# EasyEDA Pro project URADORRY-SUN1.2.eprj, schematic Main(1.2) (continued)
## Sheets (continued)
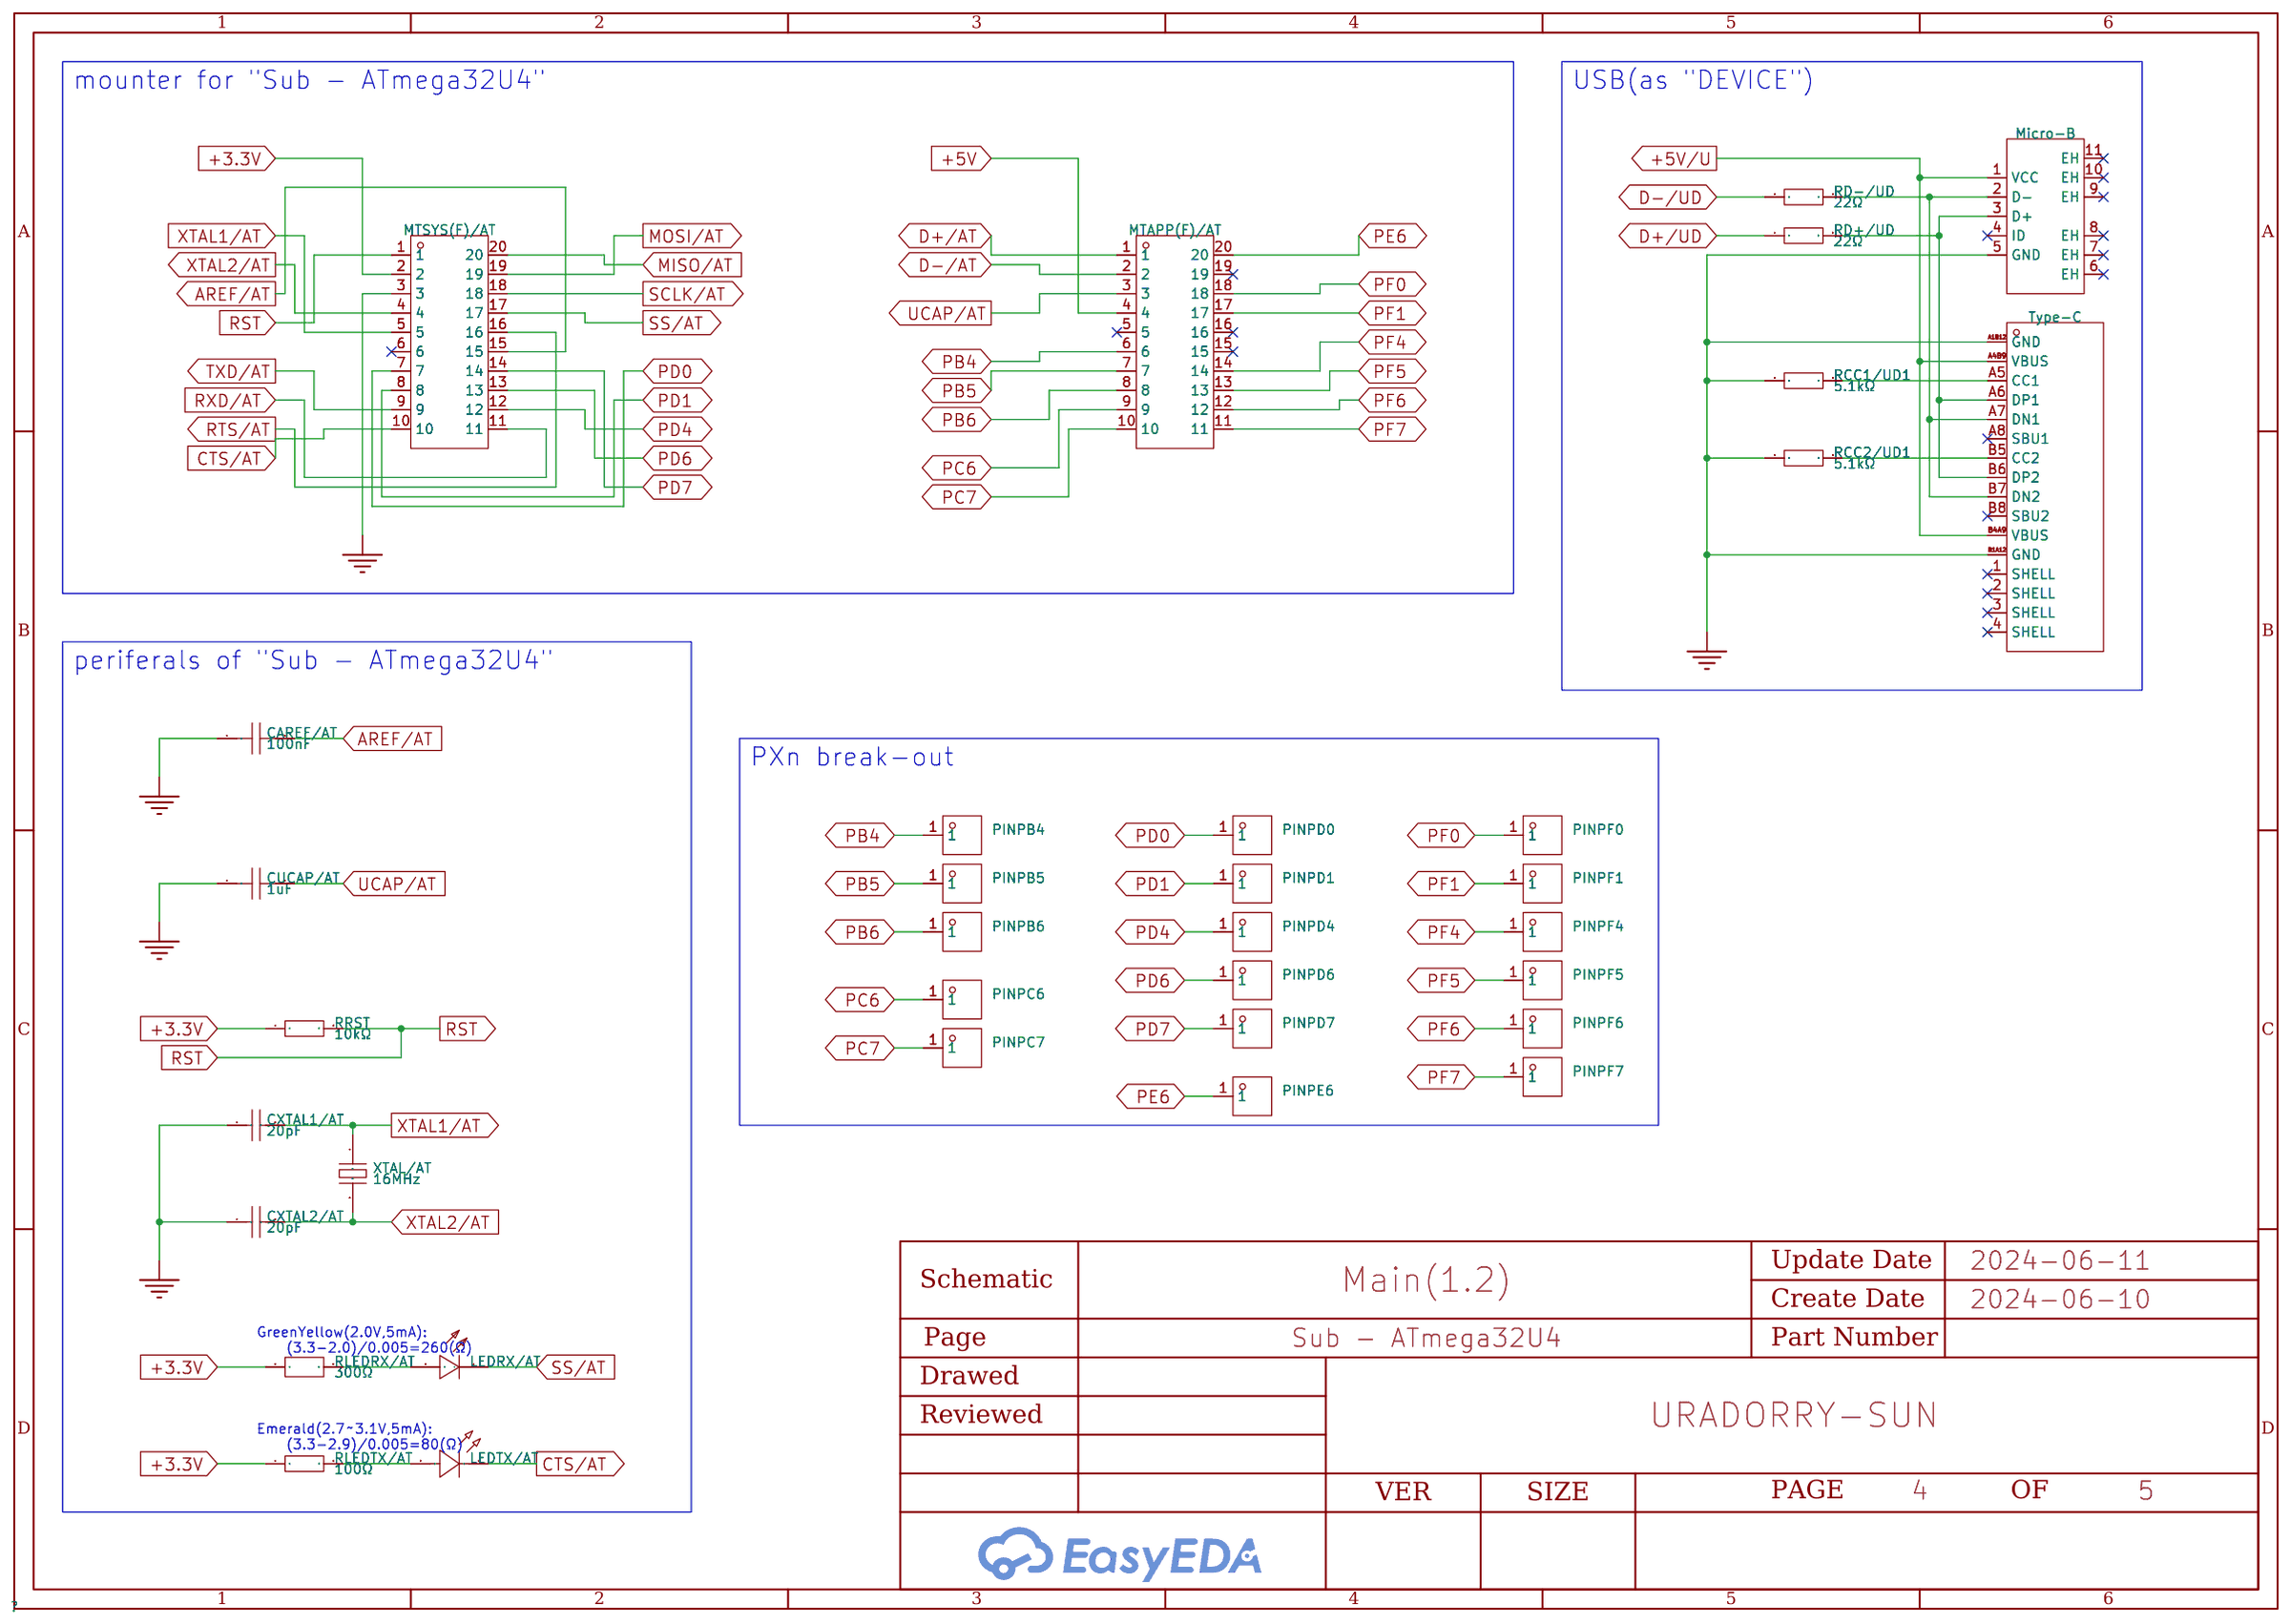
[diagram p5: Sub - ATmega32U4]
5 Sub - MAX3421E: Page Name: Sub - MAX3421E
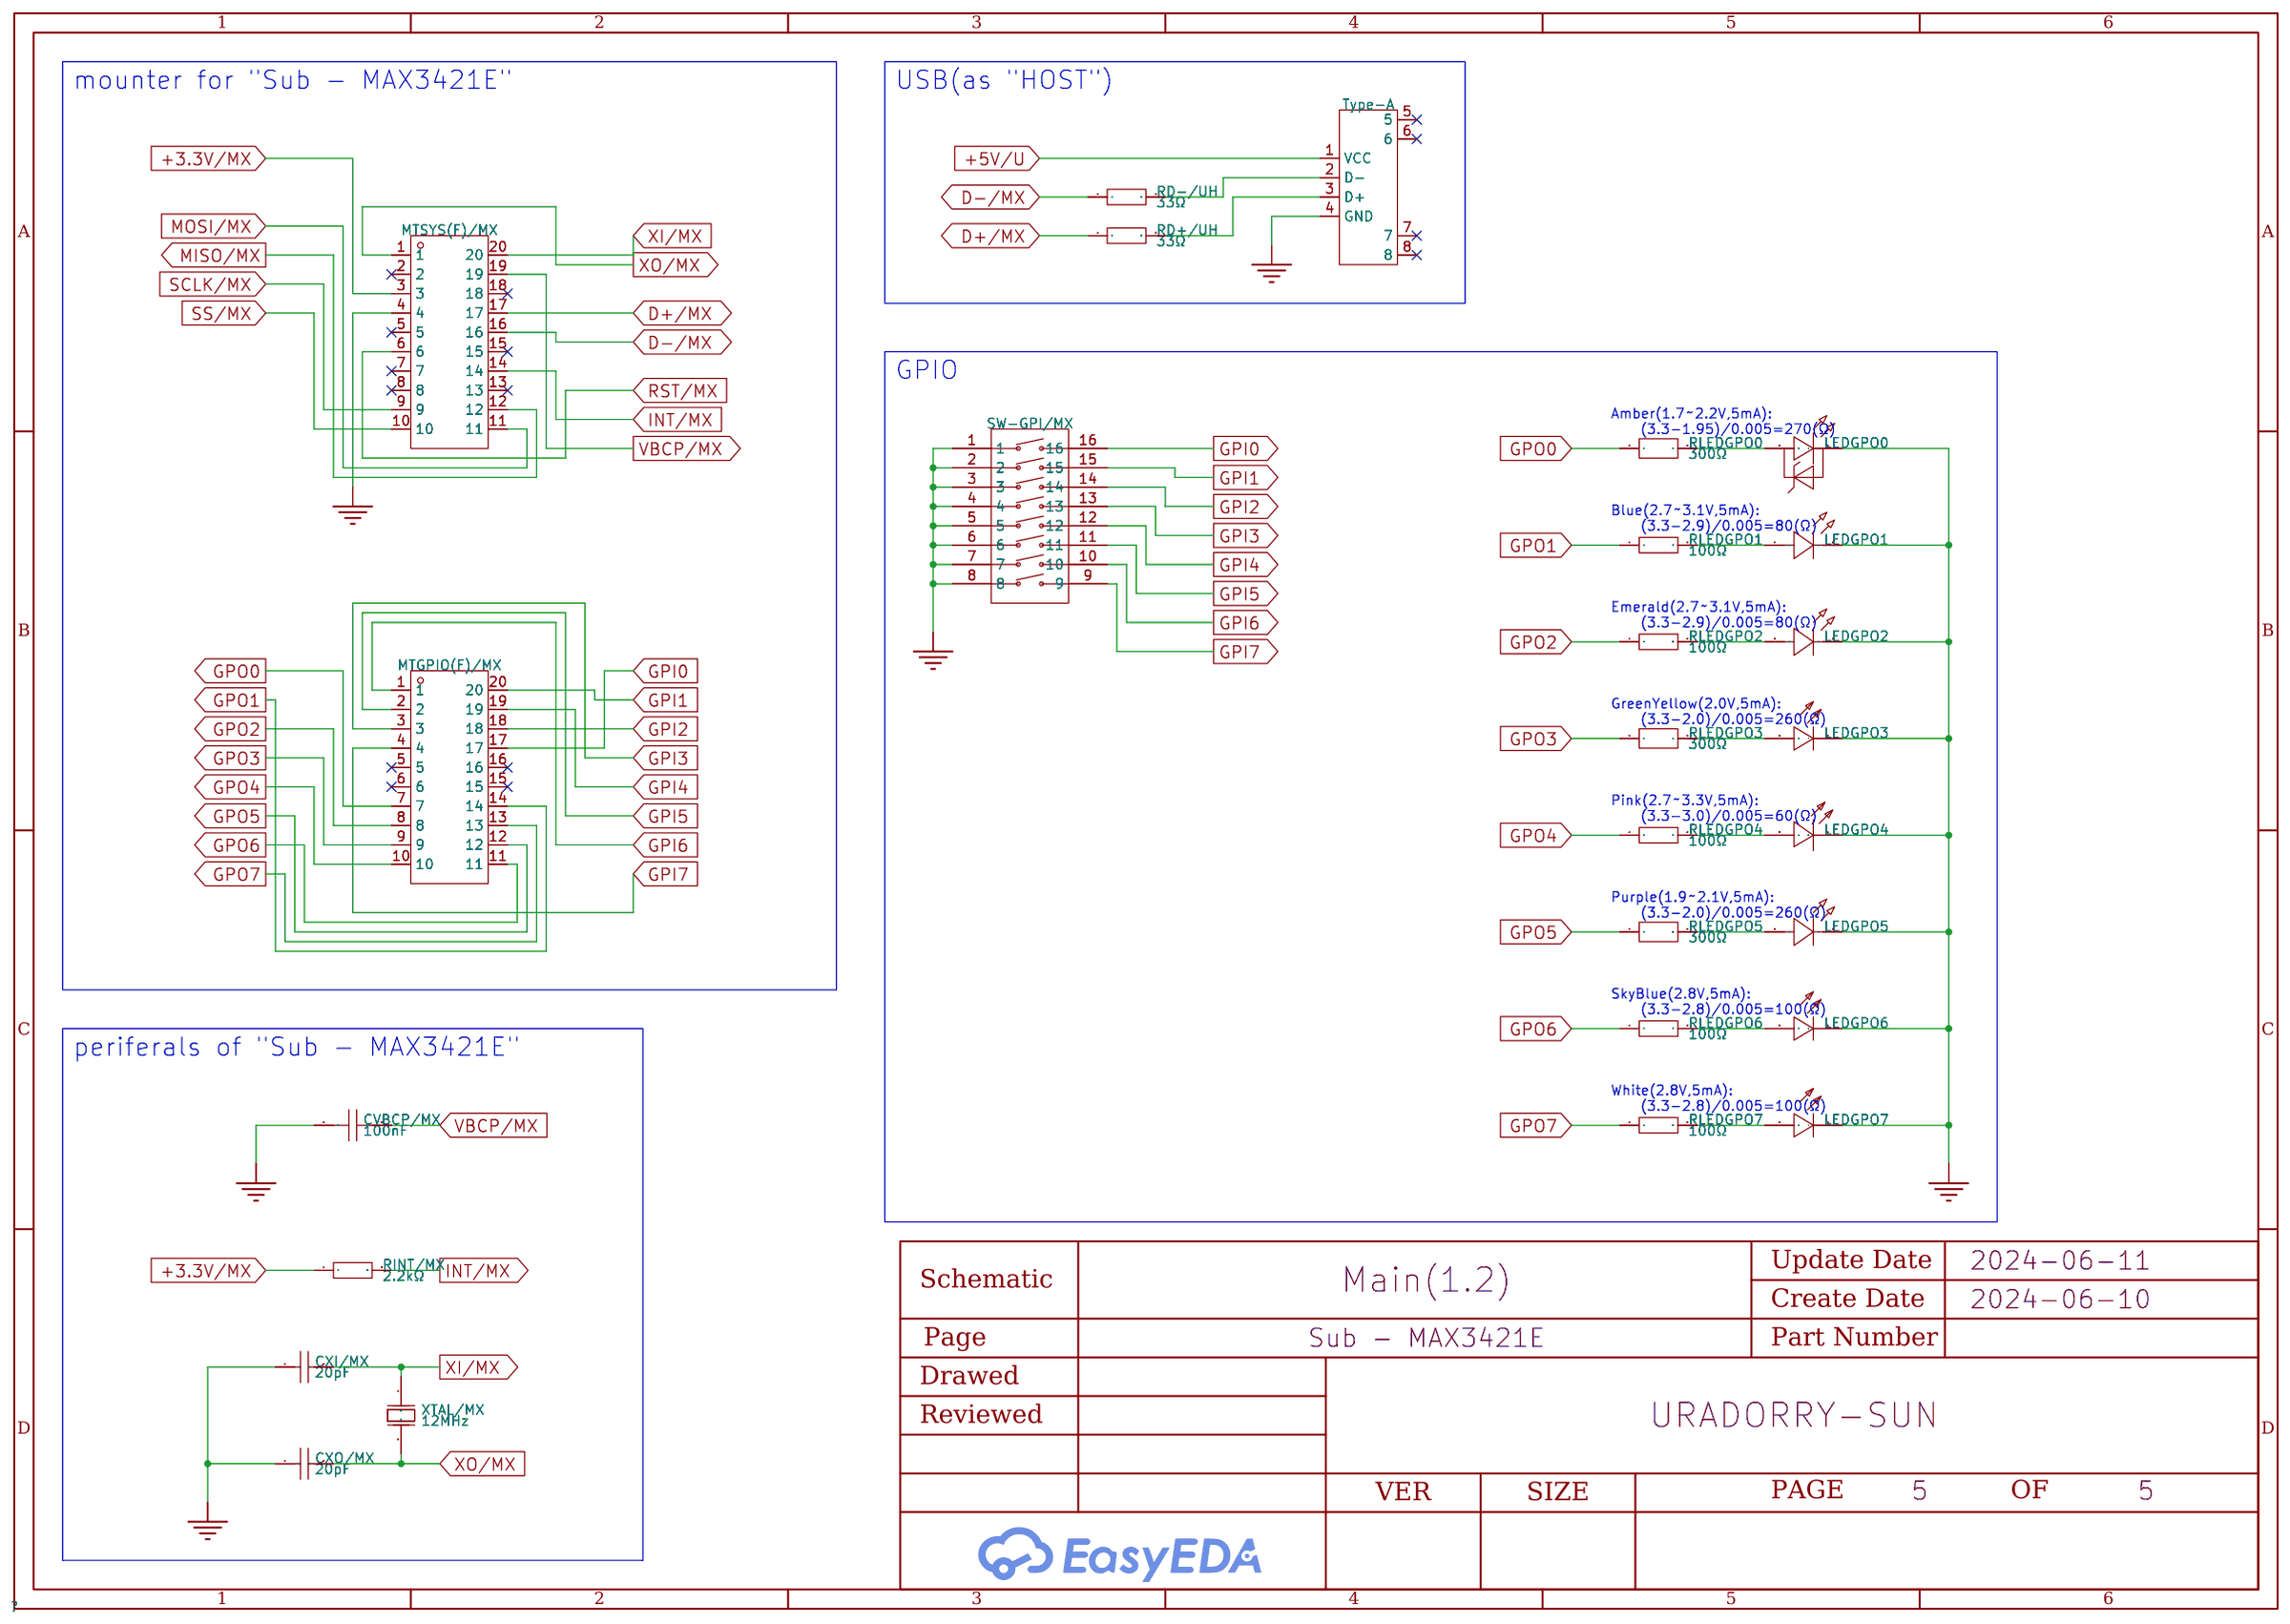
[diagram p6: Sub - MAX3421E]

## Parts
sheet base
C+3.3V1  10uF  [C0603]
C+3.3V2  1uF  [C0603]
C+3.3V3  100nF  [C0402]
CC1/LM  2.2nF  [C0402]
CC2/LM  15pF  [C0402]
CIN/LM  4.7uF  [C0402]
COUT/LM  10uF  [C0603]
CRAW  10uF  [C0603]
CS/LM  10nF  [C0402]
DVBUS  CUS08F30,H3F  [SOD-323F_L2.0-W1.6-LS2.5-RD]
FUSE+5V  BSMD1206-050-16V  [F1206]
JPRAW  PZ254V-11-02P  [HDR-TH_2P-P2.54-V-M]  (no BOM)
L/LM  4.7uH  [L0603]
LED+3.3V  XL-TD1608SURC  [LED0603-R-RD_RED]
PIN+3.3V  X5511FV-01-C30D97-0970  [HDR-TH_1P-V-F-1]  (no BOM)
PIN+5V  X5511FV-01-C30D97-0970  [HDR-TH_1P-V-F-1]  (no BOM)
PIN+7V  X5511FV-01-C30D97-0970  [HDR-TH_1P-V-F-1]  (no BOM)
PINGND  X5511FV-01-C30D97-0970  [HDR-TH_1P-V-F-1]  (no BOM)
PINICSP  FBH25401-D06S1001K6K  [IDC-TH_FBH25401-D06S1001K6K]
PINRAW  X5511FV-01-C30D97-0970  [HDR-TH_1P-V-F-1]  (no BOM)
RC/LM  47kΩ  [RES-TH_BD1.7-L3.5-P7.50-D0.5]
RF1/LM  100kΩ  [RES-ADJ-SMD_RM065-V1]
RF2/LM  20kΩ  [RES-TH_BD1.9-L3.3-P7.30-D0.5]
RLED+3.3V  300Ω  [RES-TH_BD1.7-L3.5-P7.50-D0.5]
SPLY+3.3V  AMS1117-3.3  [SOT-89-3L_L4.5-W2.5-P1.50-LS4.1-BR]
SPLY+7V  LM4510SD/NOPB  [VSON-10_L3.0-W3.0-P0.50-BL-EP-ADS8867IDRCR]
sheet serial
C1/AD  100nF  [C0402]
C2/AD  100nF  [C0402]
C3/AD  100nF  [C0402]
C4/AD  100nF  [C0402]
C5/AD  100nF  [C0402]
D-SUB(9F)  D-SUB-DR-9PCM-CB  [DB9-TH_ID09S33E4GV00LF]
JPCTS-AT  MF254V-11-02-0743  [HDR-TH_2P-P2.54-V-F-2]  (no BOM)
JPCTS-RS  MF254V-11-02-0743  [HDR-TH_2P-P2.54-V-F-2]  (no BOM)
JPRTS-AT  MF254V-11-02-0743  [HDR-TH_2P-P2.54-V-F-2]  (no BOM)
JPRTS-RS  MF254V-11-02-0743  [HDR-TH_2P-P2.54-V-F-2]  (no BOM)
JPRXD-AT  MF254V-11-02-0743  [HDR-TH_2P-P2.54-V-F-2]  (no BOM)
JPRXD-RS  MF254V-11-02-0743  [HDR-TH_2P-P2.54-V-F-2]  (no BOM)
JPTXD-AT  MF254V-11-02-0743  [HDR-TH_2P-P2.54-V-F-2]  (no BOM)
JPTXD-RS  MF254V-11-02-0743  [HDR-TH_2P-P2.54-V-F-2]  (no BOM)
UARTtoRS232C  ADM3202ARUZ-REEL7  [TSSOP-16_L5.0-W4.4-P0.65-LS6.4-BL]
sheet Sub - ATmega32U4
CAREF/AT  100nF  [C0402]
CUCAP/AT  1uF  [C0603]
CXTAL1/AT  20pF  [CAP-TH_L5.0-W3.2-P5.08-D0.6]
CXTAL2/AT  20pF  [CAP-TH_L5.0-W3.2-P5.08-D0.6]
LEDRX/AT  NCD0603C1  [LED0603-RD]
LEDTX/AT  XL-1608PGC-06  [LED0603-RD_GREEN]
Micro-B  HX MICRO 4P DIP JB  [MINI-USB-SMD_HANXIA_HXMICRO4PDIPJB]
MTAPP(F)/AT  AXK5F20547YG  [CONN-SMD_AXK5F20547YG]
MTSYS(F)/AT  AXK5F20547YG  [CONN-SMD_AXK5F20547YG]
PINPB4  X5511FV-01-C30D97-0970  [HDR-TH_1P-V-F-1]  (no BOM)
PINPB5  X5511FV-01-C30D97-0970  [HDR-TH_1P-V-F-1]  (no BOM)
PINPB6  X5511FV-01-C30D97-0970  [HDR-TH_1P-V-F-1]  (no BOM)
PINPC6  X5511FV-01-C30D97-0970  [HDR-TH_1P-V-F-1]  (no BOM)
PINPC7  X5511FV-01-C30D97-0970  [HDR-TH_1P-V-F-1]  (no BOM)
PINPD0  X5511FV-01-C30D97-0970  [HDR-TH_1P-V-F-1]  (no BOM)
PINPD1  X5511FV-01-C30D97-0970  [HDR-TH_1P-V-F-1]  (no BOM)
PINPD4  X5511FV-01-C30D97-0970  [HDR-TH_1P-V-F-1]  (no BOM)
PINPD6  X5511FV-01-C30D97-0970  [HDR-TH_1P-V-F-1]  (no BOM)
PINPD7  X5511FV-01-C30D97-0970  [HDR-TH_1P-V-F-1]  (no BOM)
PINPE6  X5511FV-01-C30D97-0970  [HDR-TH_1P-V-F-1]  (no BOM)
PINPF0  X5511FV-01-C30D97-0970  [HDR-TH_1P-V-F-1]  (no BOM)
PINPF1  X5511FV-01-C30D97-0970  [HDR-TH_1P-V-F-1]  (no BOM)
PINPF4  X5511FV-01-C30D97-0970  [HDR-TH_1P-V-F-1]  (no BOM)
PINPF5  X5511FV-01-C30D97-0970  [HDR-TH_1P-V-F-1]  (no BOM)
PINPF6  X5511FV-01-C30D97-0970  [HDR-TH_1P-V-F-1]  (no BOM)
PINPF7  X5511FV-01-C30D97-0970  [HDR-TH_1P-V-F-1]  (no BOM)
RCC1/UD1  5.1kΩ  [R0402]
RCC2/UD1  5.1kΩ  [R0402]
RD+/UD  22Ω  [R0402]
RD-/UD  22Ω  [R0402]
RLEDRX/AT  300Ω  [RES-TH_BD1.7-L3.5-P7.50-D0.5]
RLEDTX/AT  100Ω  [RES-TH_BD1.7-L3.5-P7.50-D0.5]
RRST  10kΩ  [R0402]
Type-C  TYPE-C16PIN  [USB-C-SMD_TYPE-C16PIN]
XTAL/AT  16MHz  [HC-49S_L11.0-W4.4-P4.88]
sheet Sub - MAX3421E
CVBCP/MX  100nF  [C0402]
CXI/MX  20pF  [CAP-TH_L5.0-W3.2-P5.08-D0.6]
CXO/MX  20pF  [CAP-TH_L5.0-W3.2-P5.08-D0.6]
LEDGPO0  19-217UYOC/S3112/TR8  [LED0603-RD]
LEDGPO1  XL-1608UBC-06A  [LED0603-R-RD]
LEDGPO2  XL-1608PGC-06  [LED0603-RD_GREEN]
LEDGPO3  NCD0603C1  [LED0603-RD]
LEDGPO4  XL-1608UPC-06  [LED0603-RD_PINK]
LEDGPO5  XL-1608UVC-04  [LED0603-RD_PINK]
LEDGPO6  NCD0603A1  [LED0603-RD]
LEDGPO7  NCD0603W1  [LED0603-RD]
MTGPIO(F)/MX  AXK5F20547YG  [CONN-SMD_AXK5F20547YG]
MTSYS(F)/MX  AXK5F20547YG  [CONN-SMD_AXK5F20547YG]
RD+/UH  33Ω  [R0402]
RD-/UH  33Ω  [R0402]
RINT/MX  2.2kΩ  [R0402]
RLEDGPO0  300Ω  [RES-TH_BD1.7-L3.5-P7.50-D0.5]
RLEDGPO1  100Ω  [RES-TH_BD1.7-L3.5-P7.50-D0.5]
RLEDGPO2  100Ω  [RES-TH_BD1.7-L3.5-P7.50-D0.5]
RLEDGPO3  300Ω  [RES-TH_BD1.7-L3.5-P7.50-D0.5]
RLEDGPO4  100Ω  [RES-TH_BD1.7-L3.5-P7.50-D0.5]
RLEDGPO5  300Ω  [RES-TH_BD1.7-L3.5-P7.50-D0.5]
RLEDGPO6  100Ω  [RES-TH_BD1.7-L3.5-P7.50-D0.5]
RLEDGPO7  100Ω  [RES-TH_BD1.7-L3.5-P7.50-D0.5]
SW-GPI/MX  DHN-08-V-T/R  [SW-SMD_16P-L11.4-W4.5-P1.27-LS6.7]
Type-A  10.0 4C6.3 ZB  [USB-TH_10.0-4C6.3-ZB]
XTAL/MX  12MHz  [HC-49US_L11.5-W4.5-P4.88]
sheet switch
JP+3.3V  PZ254V-11-03P  [HDR-TH_3P-P2.54-V-M]  (no BOM)
JP+5V  PZ254V-11-03P  [HDR-TH_3P-P2.54-V-M]  (no BOM)
JPD+  PZ254V-11-03P  [HDR-TH_3P-P2.54-V-M]  (no BOM)
JPD-  PZ254V-11-03P  [HDR-TH_3P-P2.54-V-M]  (no BOM)
JPMISO  PZ254V-11-03P  [HDR-TH_3P-P2.54-V-M]  (no BOM)
JPMOSI  PZ254V-11-03P  [HDR-TH_3P-P2.54-V-M]  (no BOM)
JPRAW2  PZ254V-11-03P  [HDR-TH_3P-P2.54-V-M]  (no BOM)
JPRST  PZ254V-11-03P  [HDR-TH_3P-P2.54-V-M]  (no BOM)
JPSCLK  PZ254V-11-03P  [HDR-TH_3P-P2.54-V-M]  (no BOM)
JPSS  PZ254V-11-03P  [HDR-TH_3P-P2.54-V-M]  (no BOM)
SWRST  YTSA010A0201803B  [SW-SMD_L4.0-W3.0-LS5.0-EH]

## Library data of the parts
C+3.3V1 COUT/LM CRAW = 10uF(±10%) - 0603: Capacitance:10000000pF Tolerance:±10% Tolerance:±10% Voltage Rated: Temperature Coefficient:; LCSC Part Name: 10uF ±10% 10V; Supplier Part: C6119842; Manufacturer: HRE(芯声); Manufacturer Part: CGA0603X5R106K100JT; Supplier Footprint: 0603; JLCPCB Part Class: Extended Part; Supplier: LCSC; Tolerance: ±10%
C+3.3V2 CUCAP/AT = 1uF(±5%) - 0603: Capacitance: Tolerance:±5% Tolerance:±5% Voltage Rated: Temperature Coefficient:; Supplier: LCSC; Supplier Part: C519560; Manufacturer: YAGEO(国巨); Manufacturer Part: CC0603JRX7R7BB105; JLCPCB Part Class: Extended Part; LCSC Part Name: 1uF ±5% 16V; Supplier Footprint: 0603; Datasheet: https://atta.szlcsc.com/upload/public/pdf/source/20200423/C519560_04055A817EC1D690632F33783E937415.pdf; Tolerance: ±5%
C1/AD C2/AD C3/AD C4/AD C5/AD C+3.3V3 CAREF/AT CVBCP/MX = 100nF(±5%) - 0402: Capacitance: Tolerance:±5% Tolerance:±5% Voltage Rated: Temperature Coefficient:; LCSC Part Name: 100nF ±5% 25V; Supplier Part: C2169023; Manufacturer: Kyocera AVX; Manufacturer Part: 04023C104JAT2A; Supplier Footprint: 0402; JLCPCB Part Class: Extended Part; Datasheet: https://atta.szlcsc.com/upload/public/pdf/source/20211125/9559F68C371FC513E807C3C71A51015C.pdf; Supplier: LCSC; Tolerance: ±5%
CC1/LM = 2.2nF(±5%) - 0402: Capacitance: Tolerance:±5% Tolerance:±5% Voltage Rated: Temperature Coefficient:; Supplier: LCSC; Supplier Part: C513667; Manufacturer: YAGEO(国巨); Manufacturer Part: CC0402JRX7R9BB222; JLCPCB Part Class: Extended Part; LCSC Part Name: 2.2nF ±5% 50V; Supplier Footprint: 0402; Datasheet: https://atta.szlcsc.com/upload/public/pdf/source/20200415/C513667_43ACA5E3BCCDD816EC65E9B61132137F.pdf; Tolerance: ±5%
CC2/LM = 15pF(±5%) - 0402: Capacitance: Tolerance:±5% Tolerance:±5% Voltage Rated: Temperature Coefficient:; LCSC Part Name: 15pF ±5% 50V; Supplier Part: C86285; Manufacturer: SAMSUNG(三星); Manufacturer Part: CL05C150JB5NNNC; Supplier Footprint: 0402; JLCPCB Part Class: Extended Part; Datasheet: https://atta.szlcsc.com/upload/public/pdf/source/20160218/1457707763339.pdf; Supplier: LCSC; Tolerance: ±5%
CIN/LM = 4.7uF(±10%) - 0402: Capacitance: Tolerance:±10% Tolerance:±10% Voltage Rated: Temperature Coefficient:; LCSC Part Name: 4.7uF ±10% 10V; Supplier Part: C7472956; Manufacturer: Chinocera(华瓷); Manufacturer Part: HGC0402R5475K100NTEJ; Supplier Footprint: 0402; JLCPCB Part Class: Extended Part; Datasheet: https://atta.szlcsc.com/upload/public/pdf/source/20240320/FAC3FEC40A78BC5CCCE96C232A94D860.pdf; Supplier: LCSC; Tolerance: ±10%
CS/LM = 10nF(±5%) - 0402: Capacitance: Tolerance:±5% Tolerance:±5% Voltage Rated: Temperature Coefficient:; Supplier: LCSC; Supplier Part: C354974; Manufacturer: YAGEO(国巨); Manufacturer Part: CC0402JRX7R7BB103; JLCPCB Part Class: Extended Part; LCSC Part Name: 10nF ±5% 16V; Supplier Footprint: 0402; Datasheet: https://atta.szlcsc.com/upload/public/pdf/source/20231121/E6B7358C10879AC104478A67BFFD3D0E.pdf; Tolerance: ±5%
DVBUS = 220mV(10mA) - SOD323: Forward Voltage (Vf@If):220mV@10mA Reverse Voltage (Vr):30V Average Rectified Current (Io):800mA Reverse Leakage Current (Ir):50uA@30V; Supplier Part: C150183; Supplier: LCSC; Manufacturer: TOSHIBA(东芝); JLCPCB Part Class: Extended Part; LCSC Part Name: 电压:30V 电流:800mA; Supplier Footprint: SC-76(SOD-323); Datasheet: https://atta.szlcsc.com/upload/public/pdf/source/20180126/C150183_15169561730551309331.pdf; Forward Voltage (Vf@If): 220mV@10mA; Reverse Voltage (Vr): 30V; Average Rectified Current (Io): 800mA; Reverse Leakage Current (Ir): 50uA@30V
FUSE+5V = 150～700mΩ(0.5～1.0A) - 1206: Operating Voltage (Max):16V Current Rating (Max):100A Hold Current:500mA Trip Current:1A Power Dissipation:600mW Resistance - Initial (Ri) (Min):150mΩ Resistance - Post Trip (R1) (Max):700mΩ Maximum Time to Trip:100ms Operating Temperature:-40℃~+85℃ Opera; JLCPCB Part Class: Extended Part; Supplier: LCSC; Supplier Part: C883124; Manufacturer: BHFUSE(佰宏); LCSC Part Name: 16V 500mA 1206自恢复; Supplier Footprint: 1206; Datasheet: https://atta.szlcsc.com/upload/public/pdf/source/20230512/E419278EC8529AAF514173EF221BCF4B.pdf; Operating Voltage (Max): 16V; Current Rating (Max): 100A; Hold Current: 500mA; Trip Current: 1A; Power Dissipation: 600mW; Resistance - Initial (Ri) (Min): 150mΩ; Resistance - Post Trip (R1) (Max): 700mΩ; Maximum Time to Trip: 100ms; Operating Temperature: -40℃~+85℃
JPRAW = Jumper(2M) - Plugin2.54mm: Pin Structure:1x2P Pitch:2.54mm Row Spacing:- Circluar Pins/Square Pins:Square Pins Mounting Type:Straight Number of Rows:Plugin Number of Pins:2P Current Rating (Max):- Voltage Rating (Max):- Length of Mating Pin:6mm Insulation Height:2.5mm Length of End; Supplier: LCSC; Supplier Part: C492401; Manufacturer: XFCN(兴飞); JLCPCB Part Class: Extended Part; LCSC Part Name: 间距:2.54mm 1x2P 直插 方针; Supplier Footprint: 插件,P=2.54mm; Datasheet: https://atta.szlcsc.com/upload/public/pdf/source/20200309/C492401_A812433581A9B211A7FFA413ADDFF0E5.pdf; Pin Structure: 1x2P; Pitch: 2.54mm; Circluar Pins/Square Pins: Square Pins; Mounting Type: Straight; Number of Rows: Plugin; Number of Pins: 2P; Length of Mating Pin: 6mm; Insulation Height: 2.5mm; Length of End Connection Pin: 3mm; Operating Temperature Range: -40℃~+105℃; Color: Black
L/LM = 4.7uH(±5%) - 0603: Inductance: Tolerance:±5% Tolerance:±5% Rated Current: Saturation Current (Isat):- DC Resistance (DCR): Q @ Freq:35@10MHz Frequency - Self Resonant:55MHz Ratings:; LCSC Part Name: 4.7uH ±5%; Supplier Part: C87515; Manufacturer: TDK; Manufacturer Part: MLF1608A4R7JT000; Supplier Footprint: 0603; JLCPCB Part Class: Extended Part; Datasheet: https://atta.szlcsc.com/upload/public/pdf/source/20191023/C440659_C3A2993F9C3C9B25E061479B1BCAA800.pdf; Supplier: LCSC; Tolerance: ±5%; Q @ Freq: 35@10MHz; Frequency - Self Resonant: 55MHz
LED+3.3V = Red(1.9～2.3V,5mA) - 0603: Emitted Color:Red Power Dissipation:77.5mW Forward Current:5mA Dominant Wavelength:620nm~625nm Dominant Wavelength:620nm~625nm Peak Wavelength:625nm Lens Color:无色透明透镜 Color Temperature:- Color Temperature:- Viewing Angle:30° Mounting Sytle:Positive post O; Supplier Part: C965849; Manufacturer: XINGLIGHT(成兴光); Supplier Footprint: 0603; JLCPCB Part Class: Extended Part; Datasheet: https://atta.szlcsc.com/upload/public/pdf/source/20221102/0A7DBE4EB7C89AEBCA13ED640D41EADF.pdf; Supplier: LCSC; Emitted Color: Red; Power Dissipation: 77.5mW; Forward Current: 5mA; Dominant Wavelength: 620nm~625nm; Peak Wavelength: 625nm; Lens Color: 无色透明透镜; Viewing Angle: 30°; Mounting Sytle: Positive post; Operating Temperature: -30℃~+85℃
PIN+3.3V PIN+5V PIN+7V PINGND PINPB4-PINPB6 PINPC6 PINPC7 PINPD0 PINPD1 PINPD4 PINPD6 PINPD7 PINPE6 PINPF0 PINPF1 PINPF4-PINPF7 PINRAW = Jumper(1F) - Plugin2.54mm: Holes Structure:1x1P Pitch:2.54mm Row Spacing:- Circular Hole / Square Hole:Circular Holes Mounting Type:Straight Number of Rows:Plugin Number of Holes:1P Current Rating (Max):- Voltage Rating (Max):- Holes Direction:Top Insulation Height:3mm Contact Mate; Supplier: LCSC; Supplier Part: C2883469; Manufacturer: XKB Connectivity(中国星坤); JLCPCB Part Class: Extended Part; LCSC Part Name: 间距:2.54mm 1x1P 直插; Supplier Footprint: 插件,P=2.54mm; Datasheet: https://atta.szlcsc.com/upload/public/pdf/source/20211009/43EC1C49F931A7FEC57CD081BD1C4E7E.pdf; Holes Structure: 1x1P; Pitch: 2.54mm; Circular Hole / Square Hole: Circular Holes; Mounting Type: Straight; Number of Rows: Plugin; Number of Holes: 1P; Holes Direction: Top; Insulation Height: 3mm; Contact Material: Brass; Contact Plating: Gold; Operating Temperature Range: -40℃~+105℃; Soldering Temperature(Max): 260℃